# EasyEDA Pro project 数据采集模块 V2.4.eprj

# Schematic Schematic1

## Sheets
1 采集板: Board Name: Board1; Create Date: 2024-10-21; Page Name: 采集板; Project Name: 数据采集模块 V2.4; Schematic Name: Schematic1; Update Date: 2024-12-13; Company: 嘉立创EDA; Page Size: A3; Version: V2.0
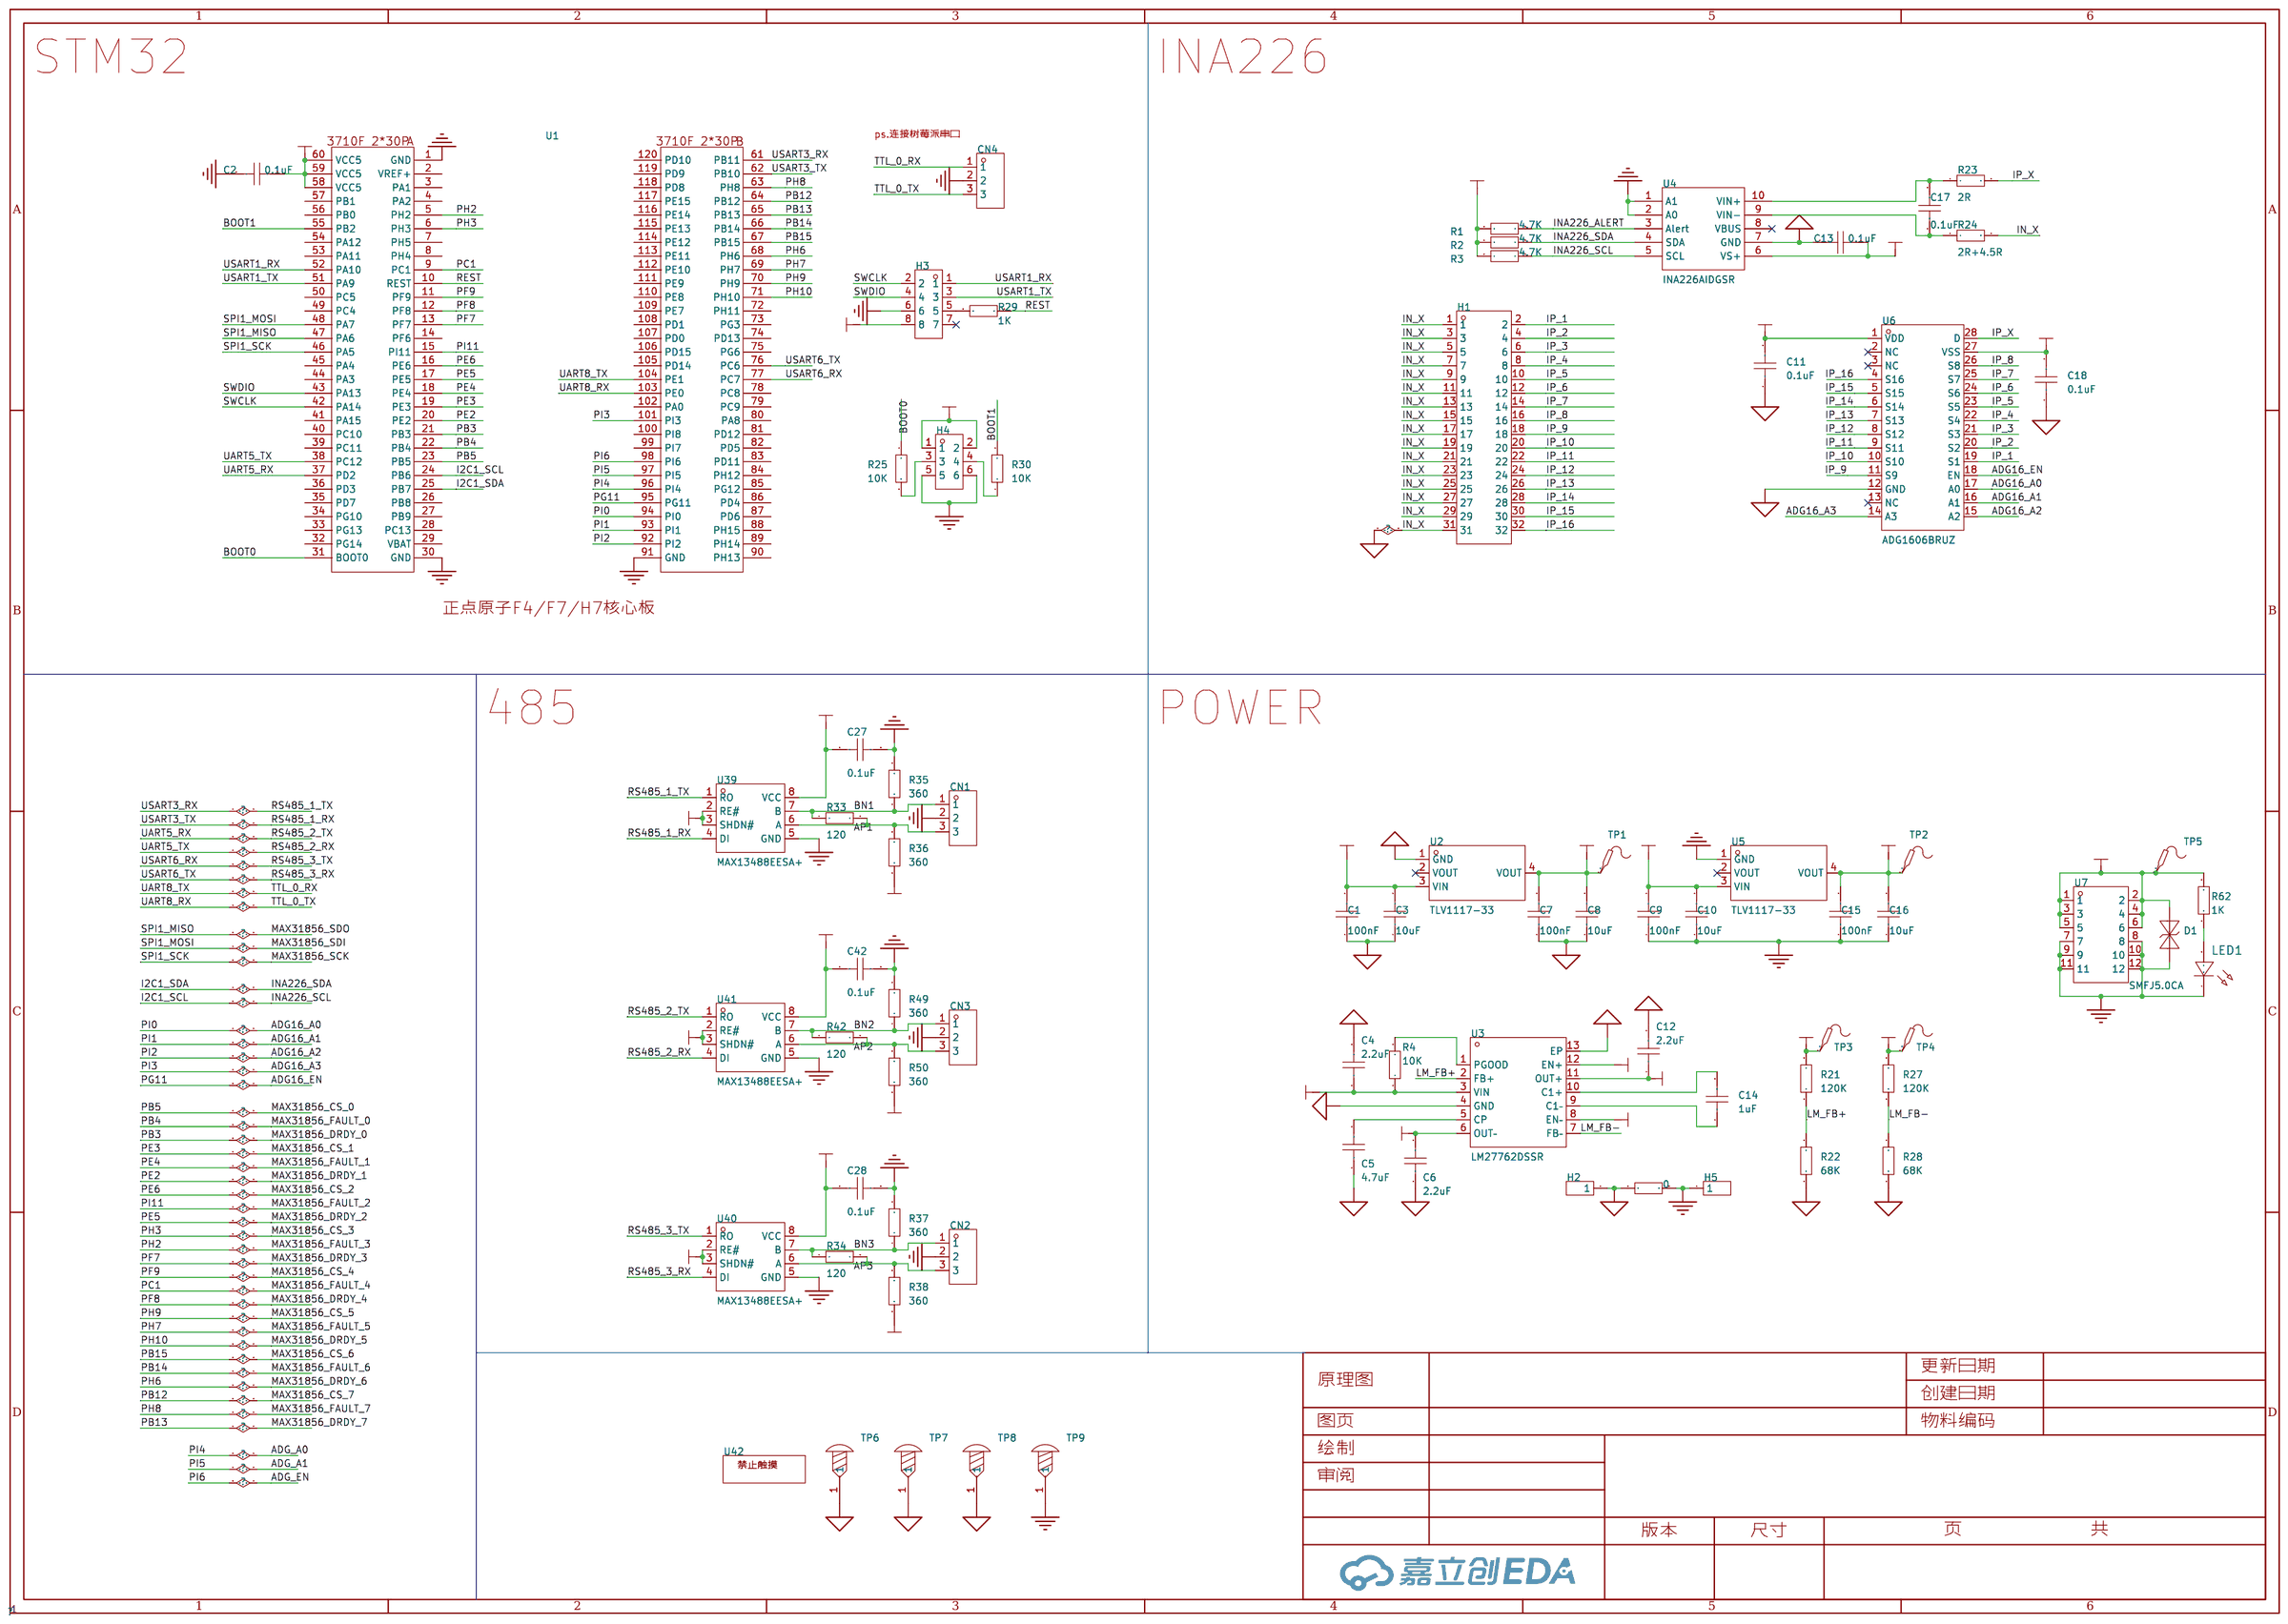
[diagram p0: 采集板]
2 MAX31856: Create Date: 2024-12-13; Page Name: MAX31856; Page Size: A4; Version: V1.0
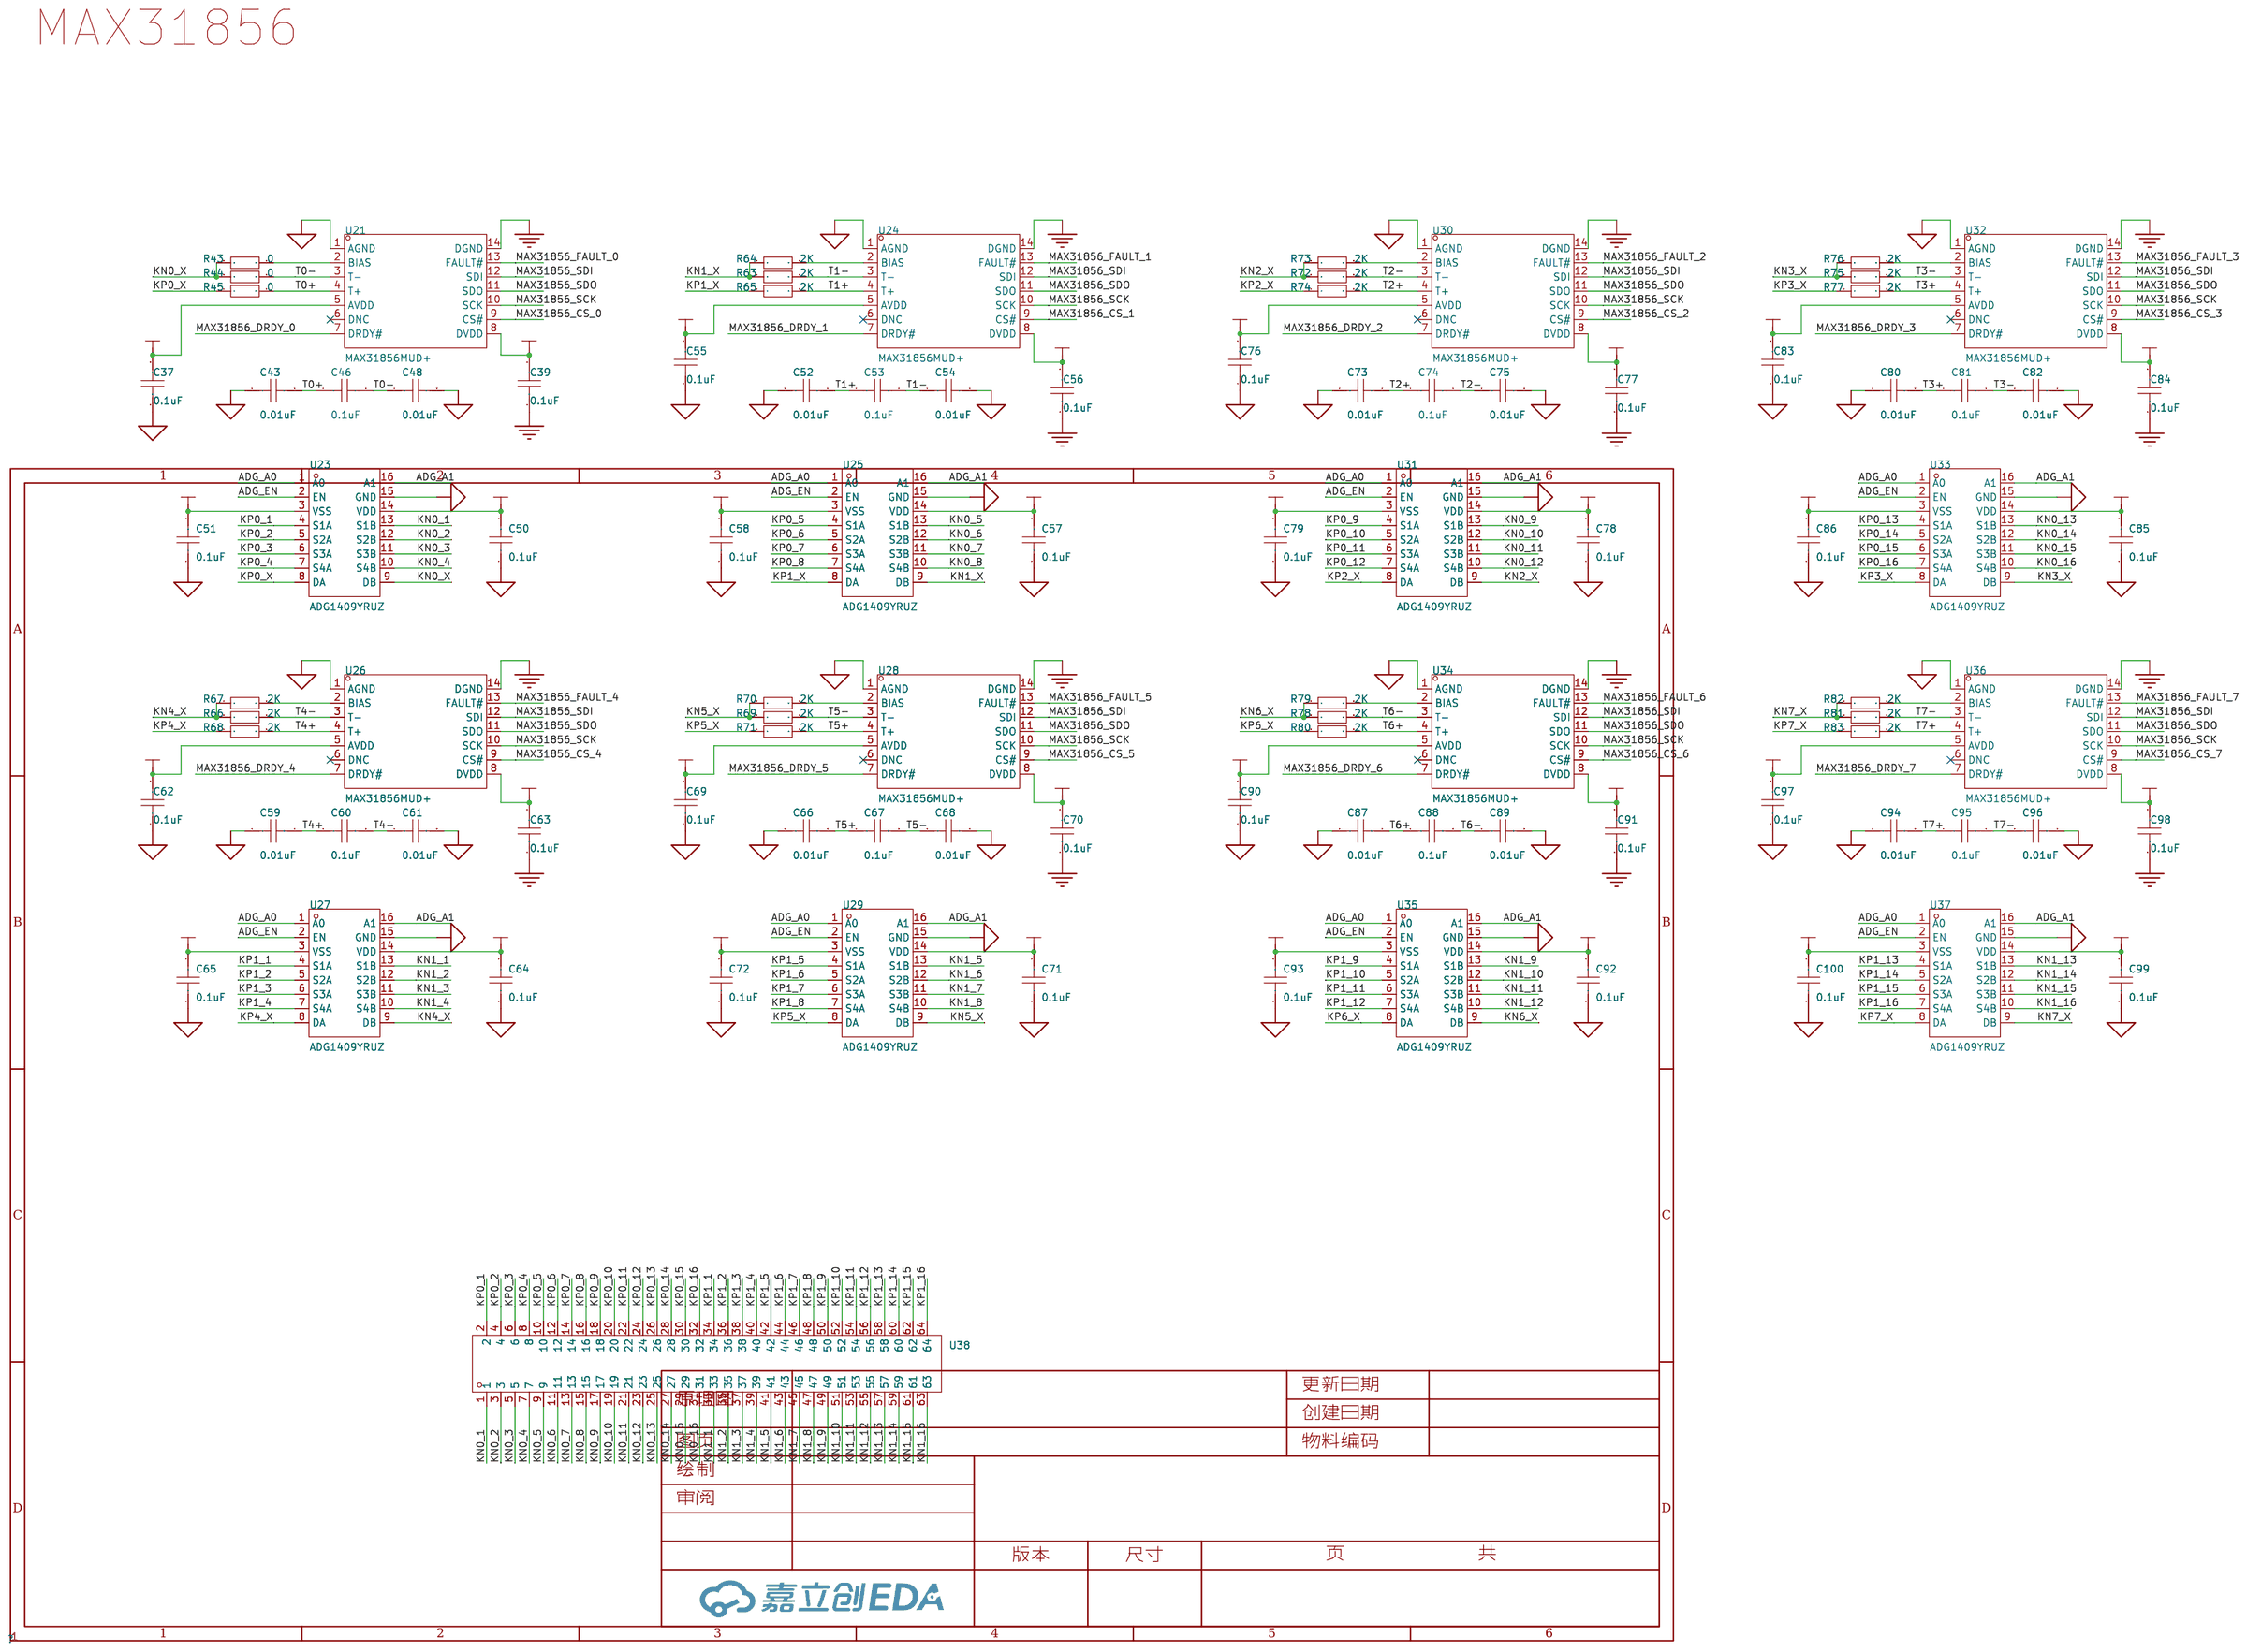
[diagram p1: MAX31856]

## Parts
sheet MAX31856
C37  0.1uF  [C0603]
C39  0.1uF  [C0603]
C43  0.01uF  [C0603]
C46  0.1uF  [C0603]
C48  0.01uF  [C0603]
C50  0.1uF  [C0603]
C51  0.1uF  [C0603]
C52  0.01uF  [C0603]
C53  0.1uF  [C0603]
C54  0.01uF  [C0603]
C55  0.1uF  [C0603]
C56  0.1uF  [C0603]
C57  0.1uF  [C0603]
C58  0.1uF  [C0603]
C59  0.01uF  [C0603]
C60  0.1uF  [C0603]
C61  0.01uF  [C0603]
C62  0.1uF  [C0603]
C63  0.1uF  [C0603]
C64  0.1uF  [C0603]
C65  0.1uF  [C0603]
C66  0.01uF  [C0603]
C67  0.1uF  [C0603]
C68  0.01uF  [C0603]
C69  0.1uF  [C0603]
C70  0.1uF  [C0603]
C71  0.1uF  [C0603]
C72  0.1uF  [C0603]
C73  0.01uF  [C0603]
C74  0.1uF  [C0603]
C75  0.01uF  [C0603]
C76  0.1uF  [C0603]
C77  0.1uF  [C0603]
C78  0.1uF  [C0603]
C79  0.1uF  [C0603]
C80  0.01uF  [C0603]
C81  0.1uF  [C0603]
C82  0.01uF  [C0603]
C83  0.1uF  [C0603]
C84  0.1uF  [C0603]
C85  0.1uF  [C0603]
C86  0.1uF  [C0603]
C87  0.01uF  [C0603]
C88  0.1uF  [C0603]
C89  0.01uF  [C0603]
C90  0.1uF  [C0603]
C91  0.1uF  [C0603]
C92  0.1uF  [C0603]
C93  0.1uF  [C0603]
C94  0.01uF  [C0603]
C95  0.1uF  [C0603]
C96  0.01uF  [C0603]
C97  0.1uF  [C0603]
C98  0.1uF  [C0603]
C99  0.1uF  [C0603]
C100  0.1uF  [C0603]
R43  0  [R0603]
R44  0  [R0603]
R45  0  [R0603]
R63  2K  [R0603]
R64  2K  [R0603]
R65  2K  [R0603]
R66  2K  [R0603]
R67  2K  [R0603]
R68  2K  [R0603]
R69  2K  [R0603]
R70  2K  [R0603]
R71  2K  [R0603]
R72  2K  [R0603]
R73  2K  [R0603]
R74  2K  [R0603]
R75  2K  [R0603]
R76  2K  [R0603]
R77  2K  [R0603]
R78  2K  [R0603]
R79  2K  [R0603]
R80  2K  [R0603]
R81  2K  [R0603]
R82  2K  [R0603]
R83  2K  [R0603]
U21  MAX31856MUD+  [TSSOP-14_L5.0-W4.4-P0.65-LS6.4-BL]
U23  ADG1409YRUZ  [TSSOP-16_L5.0-W4.4-P0.65-LS6.4-BL]
U24  MAX31856MUD+  [TSSOP-14_L5.0-W4.4-P0.65-LS6.4-BL]
U25  ADG1409YRUZ  [TSSOP-16_L5.0-W4.4-P0.65-LS6.4-BL]
U26  MAX31856MUD+  [TSSOP-14_L5.0-W4.4-P0.65-LS6.4-BL]
U27  ADG1409YRUZ  [TSSOP-16_L5.0-W4.4-P0.65-LS6.4-BL]
U28  MAX31856MUD+  [TSSOP-14_L5.0-W4.4-P0.65-LS6.4-BL]
U29  ADG1409YRUZ  [TSSOP-16_L5.0-W4.4-P0.65-LS6.4-BL]
U30  MAX31856MUD+  [TSSOP-14_L5.0-W4.4-P0.65-LS6.4-BL]
U31  ADG1409YRUZ  [TSSOP-16_L5.0-W4.4-P0.65-LS6.4-BL]
U32  MAX31856MUD+  [TSSOP-14_L5.0-W4.4-P0.65-LS6.4-BL]
U33  ADG1409YRUZ  [TSSOP-16_L5.0-W4.4-P0.65-LS6.4-BL]
U34  MAX31856MUD+  [TSSOP-14_L5.0-W4.4-P0.65-LS6.4-BL]
U35  ADG1409YRUZ  [TSSOP-16_L5.0-W4.4-P0.65-LS6.4-BL]
U36  MAX31856MUD+  [TSSOP-14_L5.0-W4.4-P0.65-LS6.4-BL]
U37  ADG1409YRUZ  [TSSOP-16_L5.0-W4.4-P0.65-LS6.4-BL]
U38  X6521WV-2x32H-C60D30  [HDR-TH_64P-P2.54-V-M-R2-C32-S2.54-3]
sheet 采集板
C1  100nF  [C0603]
C2  0.1uF  [C0603]
C3  10uF  [C0603]
C4  2.2uF  [C0805]
C5  4.7uF  [C0805]
C6  2.2uF  [C0805]
C7  100nF  [C0603]
C8  10uF  [C0603]
C9  100nF  [C0603]
C10  10uF  [C0603]
C11  0.1uF  [C0603]
C12  2.2uF  [C0805]
C13  0.1uF  [C0603]
C14  1uF  [C0603]
C15  100nF  [C0603]
C16  10uF  [C0603]
C17  0.1uF  [C0603]
C18  0.1uF  [C0603]
C27  0.1uF  [C0603]
C28  0.1uF  [C0603]
C42  0.1uF  [C0603]
CN1  ZX-XH2.54-3PZZ  [CONN-TH_3P-P2.54_2501S-3P]
CN2  ZX-XH2.54-3PZZ  [CONN-TH_3P-P2.54_2501S-3P]
CN3  ZX-XH2.54-3PZZ  [CONN-TH_3P-P2.54_2501S-3P]
CN4  ZX-XH2.54-3PZZ  [CONN-TH_3P-P2.54_2501S-3P]
D1  SMFJ5.0CA  [SOD-123_L2.7-W1.8-LS3.7-BI]
H1  X6521WV-2x16H-C60D30  [HDR-TH_32P-2.54-V-M-R2-C16-S2.54]
H2  -  [HDR-TH_1P-V-M_XKB_X4611WV-01I-C28D40]
H3  PZ254V-12-8P  [HDR-TH_8P-P2.54-V-M-R2-C4-S2.54]
H4  PZ254V-12-6P  [HDR-TH_6P-P2.54-V-M-R2-C3-S2.54]
H5  -  [HDR-TH_1P-V-M_XKB_X4611WV-01I-C28D40]
LED1  -  [LED_0603]
R1  4.7K  [R0603]
R2  4.7K  [R0603]
R3  4.7K  [R0603]
R4  10K  [R0603]
R21  120K  [R0603]
R22  68K  [R0603]
R23  2R  [R0603]
R24  2R+4.5R  [R0603]
R25  10K  [R0603]
R26  0  [R0603]
R27  120K  [R0603]
R28  68K  [R0603]
R29  1K  [R0603]
R30  10K  [R0603]
R33  120  [R0603]
R34  120  [R0603]
R35  360  [R0603]
R36  360  [R0603]
R37  360  [R0603]
R38  360  [R0603]
R42  120  [R0603]
R49  360  [R0603]
R50  360  [R0603]
R62  1K  [R0603]
TP1  -  [Test-Point-0.5mm]
TP2  -  [Test-Point-0.5mm]
TP3  -  [Test-Point-0.5mm]
TP4  -  [Test-Point-0.5mm]
TP5  -  [Test-Point-0.5mm]
TP6  -  [M3螺丝]
TP7  -  [M3螺丝]
TP8  -  [M3螺丝]
TP9  -  [M3螺丝]
U1  -  [正点原子核心板母座]
U2  TLV1117-33  [SOT-223-3_L6.5-W3.4-P2.30-LS7.0-BR]
U3  LM27762DSSR  [WSON-12_L3.0-W2.0-P0.50-BL-EP]
U4  INA226AIDGSR  [MSOP-10_L3.0-W3.0-P0.50-LS5.0-BL]
U5  TLV1117-33  [SOT-223-3_L6.5-W3.4-P2.30-LS7.0-BR]
U6  ADG1606BRUZ  [TSSOP-28_L9.7-W4.4-P0.65-LS6.4-TL]
U7  PZ254-2-06-Z-8.5KK  [HDR-TH_12P-P2.54-V-M-R2-C6-S2.54]
U39  MAX13488EESA+  [SO-8_L4.9-W3.9-P1.27-LS6.0-TL]
U40  MAX13488EESA+  [SO-8_L4.9-W3.9-P1.27-LS6.0-TL]
U41  MAX13488EESA+  [SO-8_L4.9-W3.9-P1.27-LS6.0-TL]
U42  -  [禁止触摸LOGO]

## Library data of the parts
C1-C3 C7-C11 C13-C18 C27 C28 C37 C39 C42 C43 C46 C48 C50-C100 = CAP_0603: Supplier Footprint: 0603
R1-R4 R21-R30 R33-R38 R42-R45 R49 R50 R62-R83 = Res_0603: Supplier Footprint: 0603
U21 U24 U26 U28 U30 U32 U34 U36 = MAX31856MUD+: 高精度热电偶至数字输出转换器，带线性度补偿; LCSC Part Name: MAX31856MUD; Supplier Part: C116632; Manufacturer: ADI(亚德诺)/MAXIM(美信); Supplier Footprint: TSSOP-14; JLCPCB Part Class: 扩展库; Datasheet: https://atta.szlcsc.com/upload/public/pdf/source/20180413/C116632_831D9B1C9ECFD227FC0EF5729DAE9663.pdf; Supplier: LCSC
U23 U25 U27 U29 U31 U33 U35 U37 = ADG1409YRUZ: 开关电路:单刀四掷(SP4T);通道数:2;导通电阻(Ron@VCC):4.7Ω;; Supplier Part: C579016; Manufacturer: ADI(亚德诺); Supplier Footprint: TSSOP-16; JLCPCB Part Class: 扩展库; Datasheet: https://atta.szlcsc.com/upload/public/pdf/source/20180613/C206600_D6F6D7C91B7C8F29849FBB062317D942.pdf; Supplier: LCSC; Switch Circuit: 单刀四掷(SP4T); Number of Channels: 2; Supply Voltage: 5V~16.5V; Turn-on time: 120ns; On-State Resistance (Max): 4.7Ω; Turn-off time: 120ns
U38 = X6521WV-2x32H-C60D30: 插针结构:2x32P;间距:2.54mm;行距:2.54mm;圆针/方针:方针;安装类型:-;排数:双排;总PIN位数:64P;额定电流:3A;额定电压:250V;配合针长度:-;塑高:2.5mm;端接针长度:-;触头材质:黄铜;触头镀层:金;工作温度范围:-40℃~+105℃;焊接温度(最大值):260℃;颜色:黑色;; LCSC Part Name: 2x32P 间距:2.54mm 方针; Supplier Part: C2883966; Manufacturer: XKB Connection(中国星坤); Supplier Footprint: 插件,P=2.54mm; JLCPCB Part Class: 扩展库; Datasheet: https://atta.szlcsc.com/upload/public/pdf/source/20230515/3562B41AC32B1731F21EFD73DC35CC6C.pdf; Supplier: LCSC; Pin Structure: 2x32P; Pitch: 2.54mm; Row Spacing: 2.54mm; Circluar Pins/Square Pins: 方针; Number of Rows: 双排; Number of Pins: 64P; Current Rating (Max): 3A; Voltage Rating (Max): 250V; Insulation Height: 2.5mm; Contact Material: 黄铜; Contact Plating: 金; Operating Temperature Range: -40℃~+105℃; Soldering Temperature(Max): 260℃; Color: 黑色
C4-C6 C12 = CAP_0805: Supplier Footprint: 0805
CN1-CN4 = ZX-XH2.54-3PZZ: 插针结构:1x3P;间距:2.54mm;安装方式:直插;参考系列:XH;总PIN数:3P;排数:1;每排PIN数:3;行距:-;额定电流:3A;触头材质:黄铜;触头镀层:锡;工作温度范围:-25℃~+85℃;; Supplier Part: C7429633; Manufacturer: Megastar(兆星); Supplier Footprint: 插件,P=2.54mm; JLCPCB Part Class: 扩展库; Datasheet: https://atta.szlcsc.com/upload/public/pdf/source/20230619/AE17037A2CFDBE8D9CBA775D61AD0A84.pdf; Supplier: LCSC; Pins Structure: 1x3P; Pitch: 2.54mm; Mounting Style: 直插; Reference Series: XH; Number of Pins: 3P; Number of Rows: 1; Number of PINs Per Row: 3; Current Rating (Max): 3A; Contact Material: 黄铜; Contact Plating: 锡; Operating Temperature Range: -25℃~+85℃
D1 = SMFJ5.0CA: 反向截止电压(Vrwm):5V;最大钳位电压:9.2V;峰值脉冲电流(Ipp)@10/1000us:21.7A;击穿电压:6.4V;; Supplier Part: C2905638; Manufacturer: TECH PUBLIC(台舟); Supplier Footprint: SOD-123FL; JLCPCB Part Class: 扩展库; Datasheet: https://atta.szlcsc.com/upload/public/pdf/source/20211026/3B8FA2C5551EFBFD99ABC853C5618374.pdf; Supplier: LCSC; Reverse Stand-Off Voltage (Vrwm): 5V; Maximum Clamping Voltage: 9.2V; Peak Pulse Current (Ipp)@10/1000us: 21.7A; Breakdown Voltage: 6.4V; Reverse Leakage Current (Ir): 400uA; Type: TVS
H1 = X6521WV-2x16H-C60D30: 插针结构:2x16P;间距:2.54mm;行距:2.54mm;圆针/方针:方针;安装类型:-;排数:双排;总PIN位数:32P;额定电流:3A;额定电压:250V;配合针长度:-;塑高:2.5mm;端接针长度:-;触头材质:黄铜;触头镀层:金;工作温度范围:-40℃~+105℃;焊接温度(最大值):260℃;颜色:黑色;; LCSC Part Name: 2x16P 间距:2.54mm 方针; Supplier Part: C725888; Manufacturer: XKB Connection(中国星坤); Supplier Footprint: 插件,P=2.54mm; JLCPCB Part Class: 扩展库; Datasheet: https://atta.szlcsc.com/upload/public/pdf/source/20211009/DE33EBA4104B5B447A7BD8383FBBA145.pdf; Supplier: LCSC; Pin Structure: 2x16P; Pitch: 2.54mm; Row Spacing: 2.54mm; Circluar Pins/Square Pins: 方针; Number of Rows: 双排; Number of Pins: 32P; Current Rating (Max): 3A; Voltage Rating (Max): 250V; Insulation Height: 2.5mm; Contact Material: 黄铜; Contact Plating: 金; Operating Temperature Range: -40℃~+105℃; Soldering Temperature(Max): 260℃; Color: 黑色
H2 H5 = HDR-M_2.54_1x1P: Supplier Part: C81276; Supplier Footprint: 插件; JLCPCB Part Class: Extended Part
H3 = PZ254V-12-8P: 插针结构:2x4P;间距:2.54mm;行距:2.54mm;圆针/方针:方针;安装类型:直插;排数:双排;总PIN位数:8P;额定电流:-;额定电压:-;配合针长度:6mm;塑高:2.5mm;端接针长度:3mm;触头材质:黄铜;触头镀层:-;工作温度范围:-40℃~+105℃;颜色:黑色;; LCSC Part Name: 间距:2.54mm 2x4P 直插 方针; Supplier Part: C492421; Manufacturer: XFCN(兴飞); Supplier Footprint: 插件,P=2.54mm; JLCPCB Part Class: 扩展库; Datasheet: https://atta.szlcsc.com/upload/public/pdf/source/20200309/C492421_DC8A206AF99CD7755BD4A5B0BC48200B.pdf; Supplier: LCSC; Pin Structure: 2x4P; Pitch: 2.54mm; Row Spacing: 2.54mm; Circluar Pins/Square Pins: 方针; Mounting Type: 直插; Number of Rows: 双排; Number of Pins: 8P; Length of Mating Pin: 6mm; Insulation Height: 2.5mm; Length of End Connection Pin: 3mm; Contact Material: 黄铜; Operating Temperature Range: -40℃~+105℃; Color: 黑色
H4 = PZ254V-12-6P: 插针结构:2x3P;间距:2.54mm;行距:2.54mm;圆针/方针:方针;安装类型:直插;排数:双排;总PIN位数:6P;额定电流:-;额定电压:-;配合针长度:6mm;塑高:2.5mm;端接针长度:3mm;触头材质:黄铜;触头镀层:-;工作温度范围:-40℃~+105℃;颜色:黑色;; LCSC Part Name: 间距:2.54mm 2x3P 直插 方针; Supplier Part: C492420; Manufacturer: XFCN(兴飞); Supplier Footprint: 插件,P=2.54mm; JLCPCB Part Class: 扩展库; Datasheet: https://atta.szlcsc.com/upload/public/pdf/source/20200309/C492420_BAECB307B001054C09D200388220EAE6.pdf; Supplier: LCSC; Pin Structure: 2x3P; Pitch: 2.54mm; Row Spacing: 2.54mm; Circluar Pins/Square Pins: 方针; Mounting Type: 直插; Number of Rows: 双排; Number of Pins: 6P; Length of Mating Pin: 6mm; Insulation Height: 2.5mm; Length of End Connection Pin: 3mm; Contact Material: 黄铜; Operating Temperature Range: -40℃~+105℃; Color: 黑色
LED1 = LED_0603-R: Supplier Footprint: 0603
TP1-TP5 = Test-Point: Test Point 测试点
TP6-TP9 = M3螺丝: Supplier Footprint: 插件
U1 = STM32F4F7H7核心板母座3710F
U2 U5 = AMS1117-3.3_C6186: 输出类型:固定;最大输入电压:-;输出电压:3.3V;最大输出电流:1A;电源纹波抑制比(PSRR):72dB@(120Hz);输出极性:正极;; LCSC Part Name: 输出3.3V 1A; Supplier Part: C6186; Manufacturer: AMS; Supplier Footprint: SOT-223-3; JLCPCB Part Class: 基础库; Datasheet: https://atta.szlcsc.com/upload/public/pdf/source/20180727/C6186_7A095716F0823C02F1997A905E26C086.pdf; Supplier: LCSC; Output Type: 固定; Output Voltage: 3.3V; MAX Output Current: 1A; Power Supply Rejection Ratio (PSRR): 72dB@(120Hz); Dropout Voltage: 1.3V@(800mA); Output Polarity: 正极; Number of Outputs: 1
U3 = LM27762DSSR: LM27762 带有集成 LDO 的低噪声正负输出电荷泵; Supplier Part: C473398; Manufacturer: TI(德州仪器); Supplier Footprint: WSON-12-EP(2x3); JLCPCB Part Class: 扩展库; Datasheet: https://www.ti.com/cn/lit/gpn/lm27762; Supplier: LCSC
U4 = INA226AIDGSR: INA226 支持报警功能的 36V、双向、超高精度、低侧/高侧、I2C 输出电流/功率监控器; Supplier Part: C49851; Manufacturer: TI(德州仪器); Supplier Footprint: MSOP-10; JLCPCB Part Class: 扩展库; Datasheet: https://www.ti.com/cn/lit/gpn/ina226; Supplier: LCSC; Supply Voltage: 0V~36V; Operating Temperature: -40℃~+125℃
U6 = ADG1606BRUZ: 开关电路:-;通道数:1;导通电阻(Ron@VCC):5Ω;; LCSC Part Name: 4.5 Ω RON、16通道/差分8通道、±5V/+12 V/+5 V/+3.3 V多路复用器; Supplier Part: C207703; Manufacturer: ADI(亚德诺); Supplier Footprint: TSSOP-28; JLCPCB Part Class: 扩展库; Datasheet: https://atta.szlcsc.com/upload/public/pdf/source/20191127/C462160_2CD646546AC04A1550D4B2E0F11FE9B0.pdf; Supplier: LCSC; Number of Channels: 1; Supply Voltage: 3.3V~16V; Turn-on time: 128ns; On-State Resistance (Max): 5Ω; Turn-off time: 109ns
U7 = PZ254-2-06-Z-8.5KK: LCSC Part Name: 2.54mm 被合并商品; Supplier Part: C3012246; Supplier Footprint: 插件,P=2.54mm; JLCPCB Part Class: 扩展库; Supplier: LCSC
U39-U41 = MAX13488EESA+: 类型:收发器;数据速率:16Mbps;驱动器/接收器:1/1;; LCSC Part Name: MAX13488EESA; Supplier Part: C143343; Manufacturer: ADI(亚德诺)/MAXIM(美信); Supplier Footprint: SO-8; JLCPCB Part Class: 扩展库; Datasheet: https://atta.szlcsc.com/upload/public/pdf/source/20171202/C156258_15122106256341160224.pdf; Supplier: LCSC; Types: 收发器; Supply Voltage: 4.75V~5.25V; Data Rate: 16Mbps; Driver/receiver: 1/1; Operating Temperature: -40℃~+85℃
U42 = 禁止触摸LOGO
